# EasyEDA Pro project WearableGasDetect.eprj, board PCB1
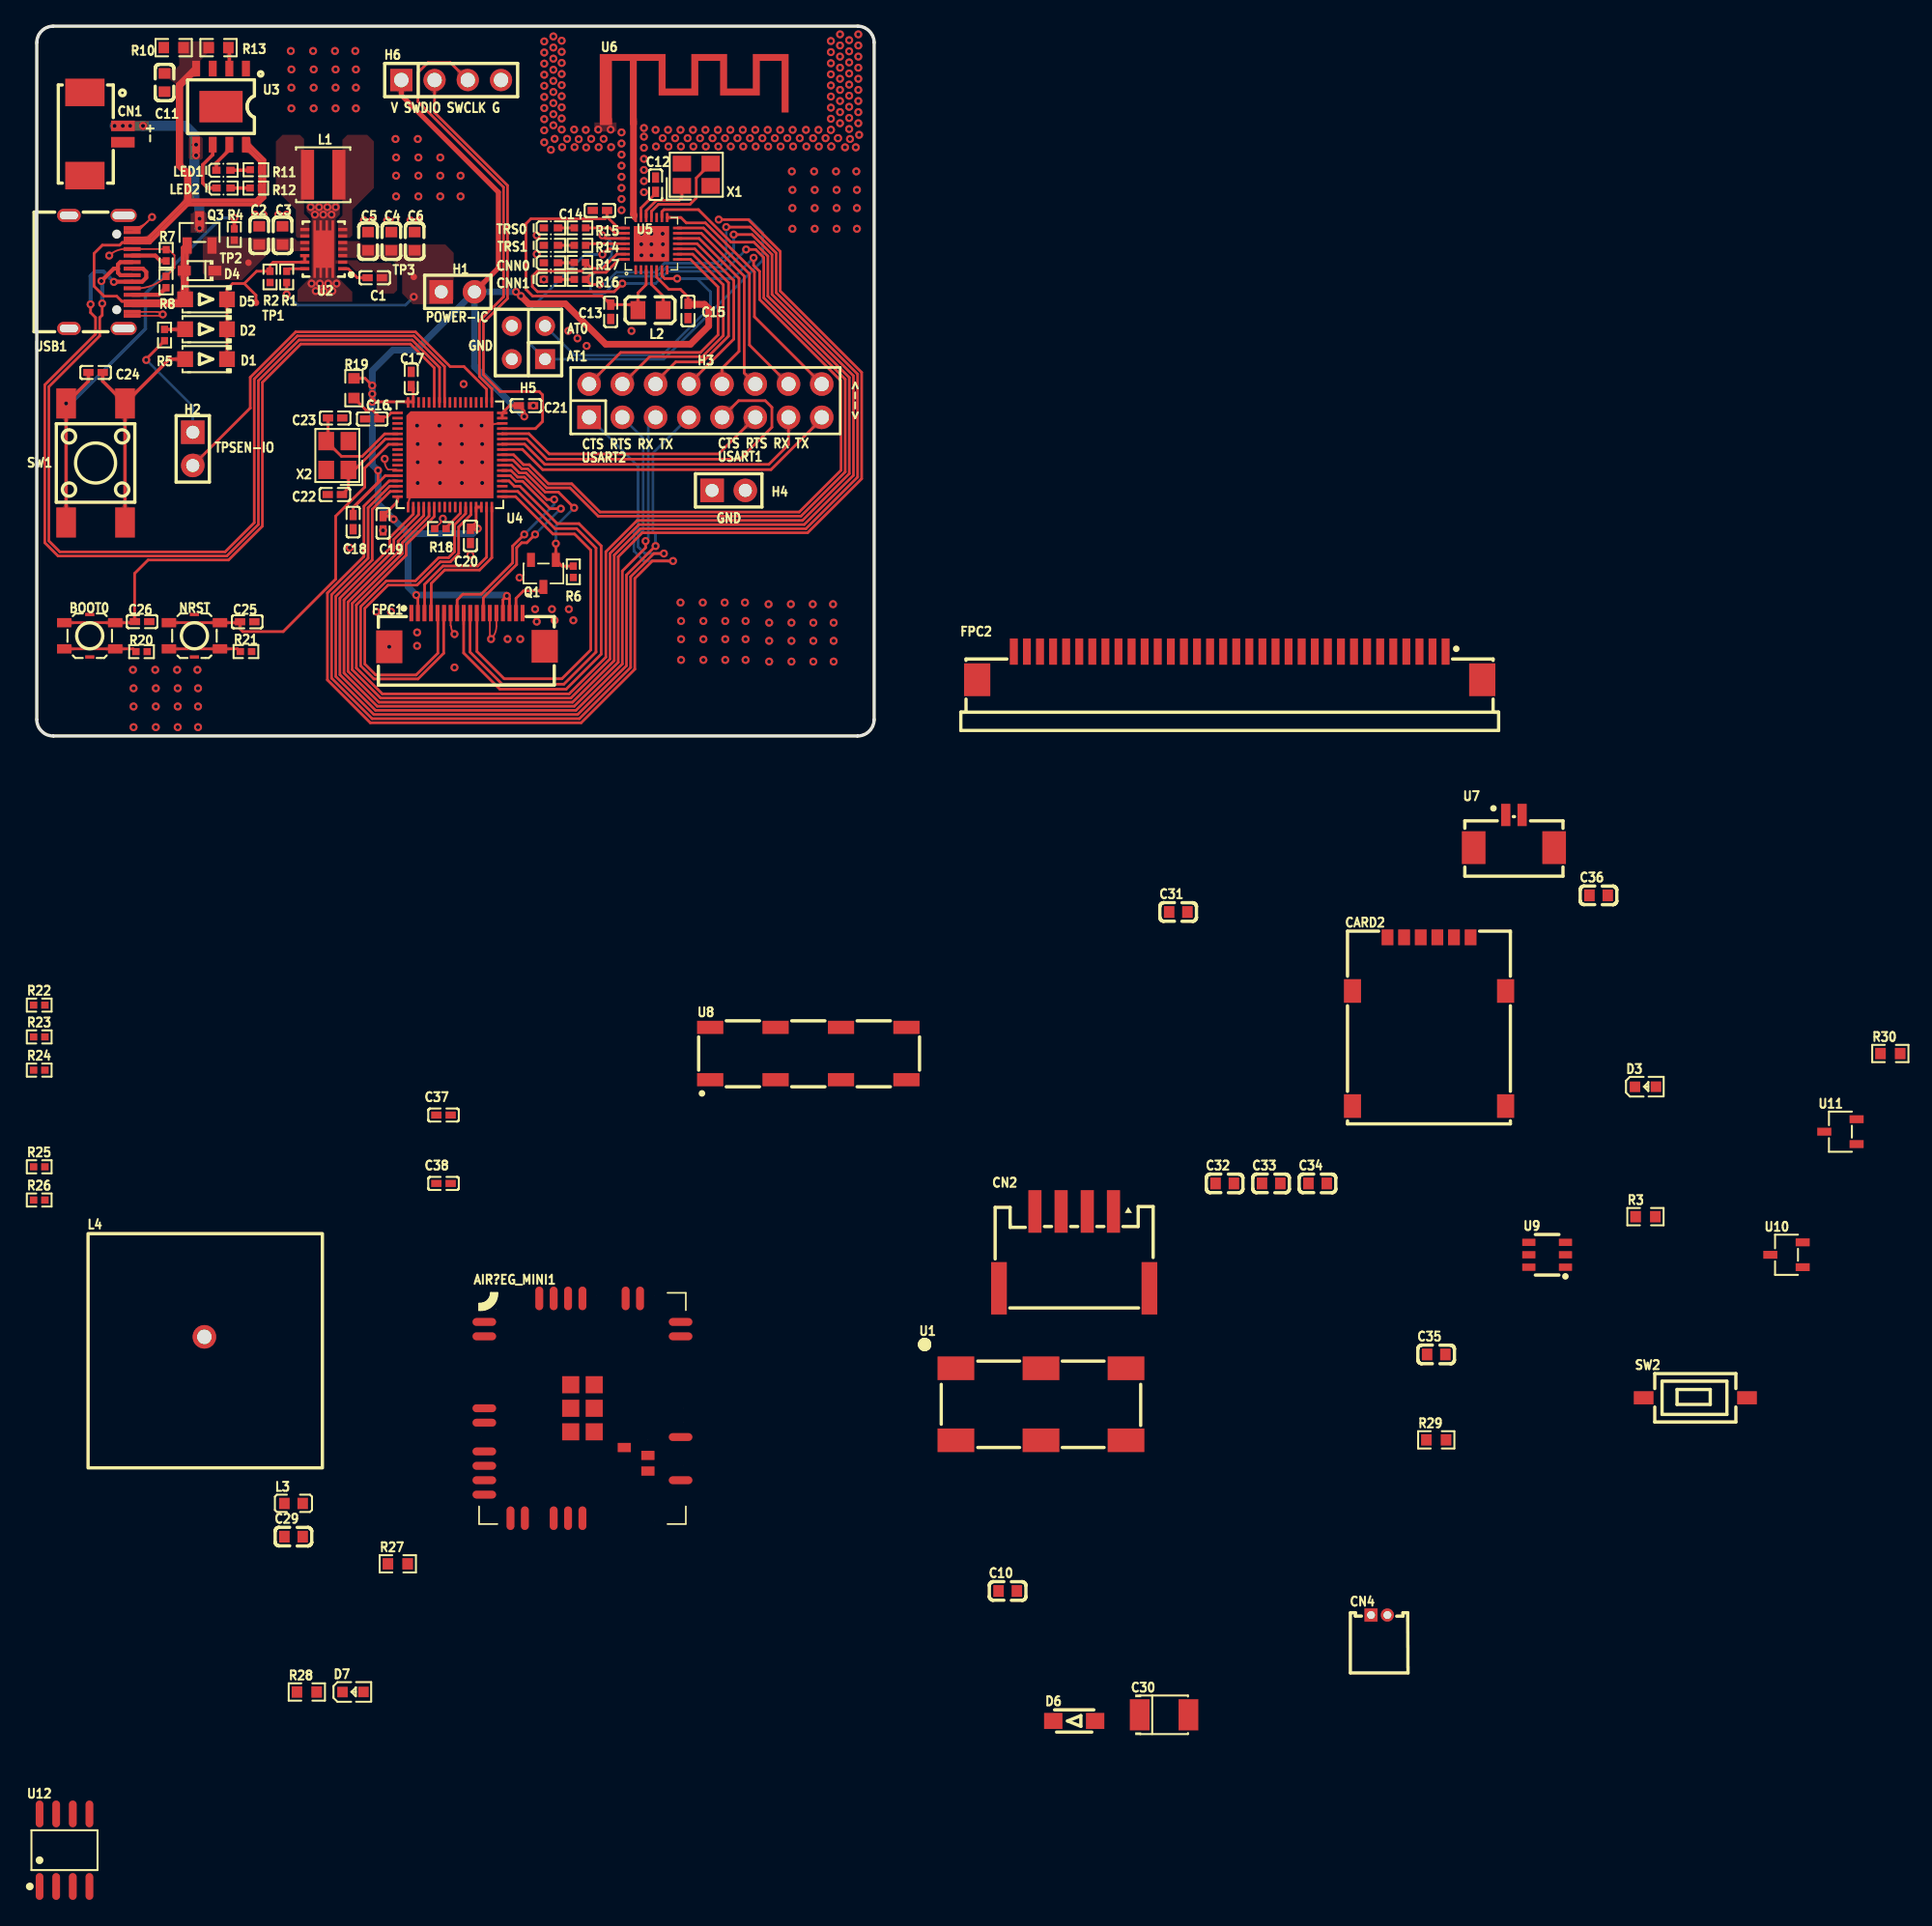
[diagram p6: board, top side]
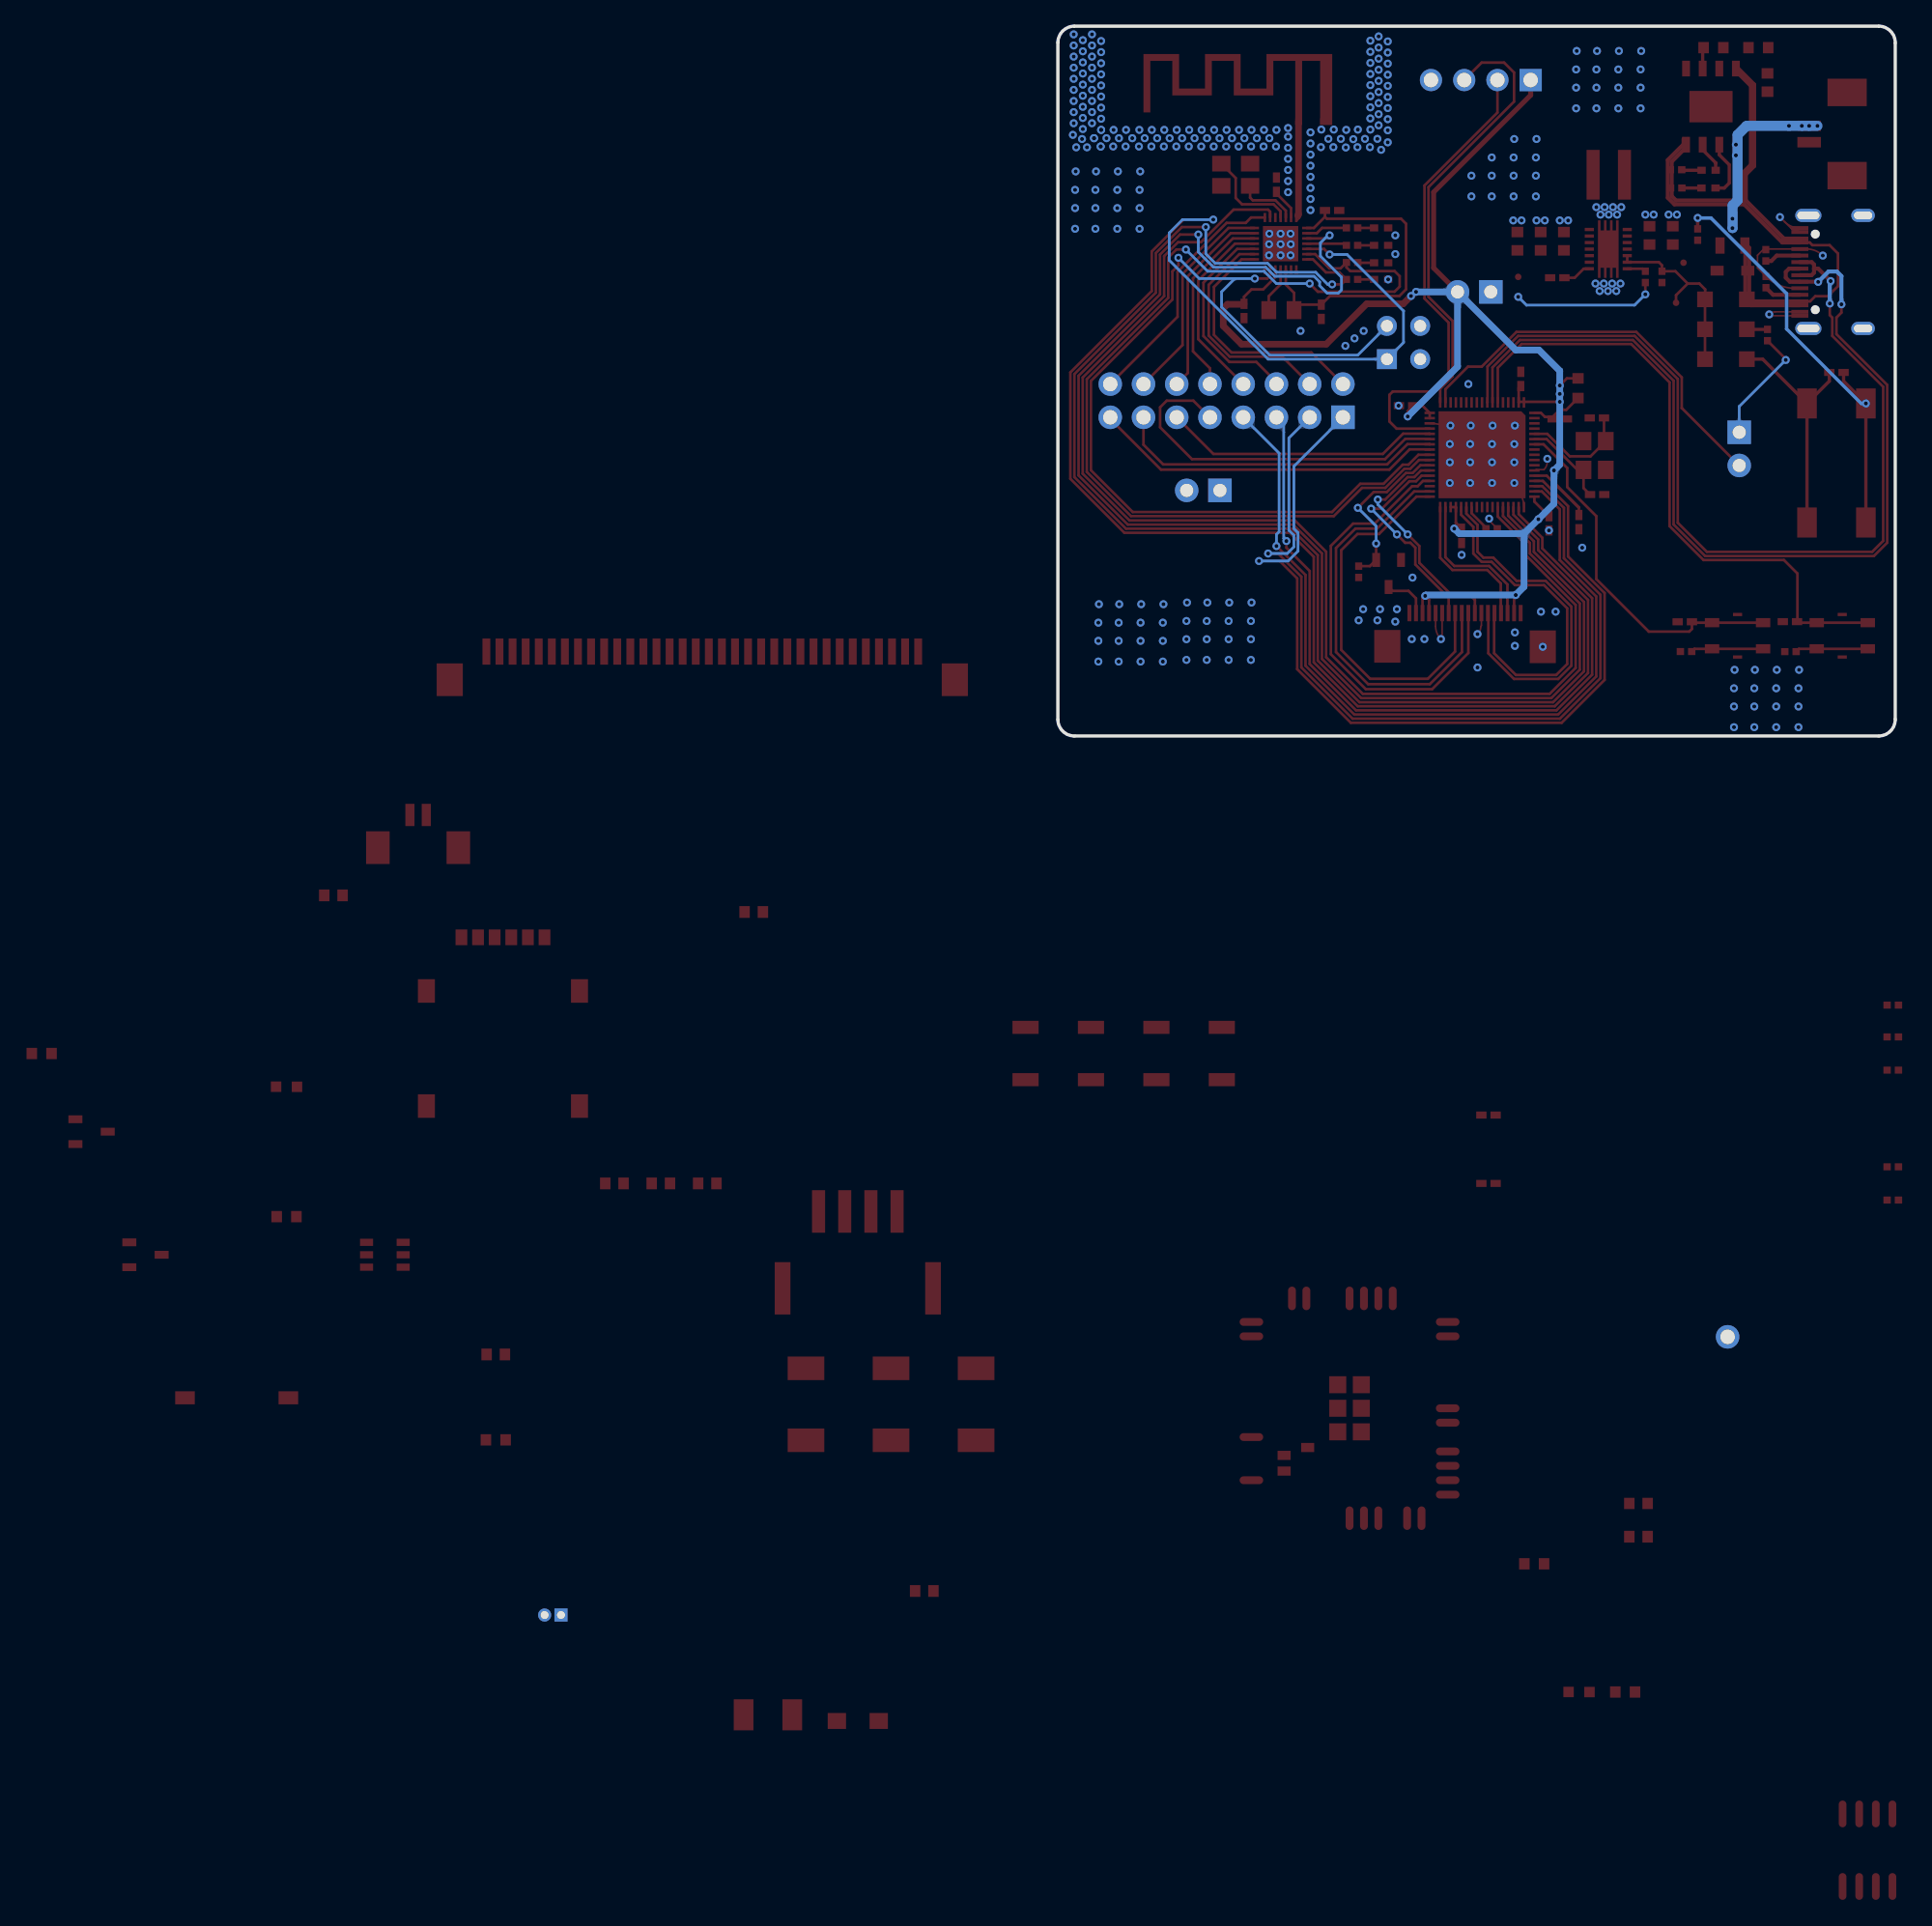
[diagram p7: board, bottom side, seen from below]

Outline 64 x 54.26 mm; copper layers: Top Layer, Bottom Layer. Coordinates in mm from the lower left corner of the outline.
Outline path: 0,52.99 0,1.27 arc(0.37,0.37) 1.27,0 62.73,0 arc(63.62,0.37) 64,1.27 64,52.99 arc(63.62,53.89) 62.73,54.26 1.27,54.26 arc(0.37,53.89) 0,52.99
Stack: Top Layer 0.035mm - / Dielectric1 1.51mm FR4 er 4.5 / Bottom Layer 0.035mm -

## Design rules (mm)
template: JLCPCB Capability(Two Layers Board)
spacing copperThickness1oz (default): track to track 0.102, other pairs 0.152 to 0.3
spacing copperThickness2oz: track to track 0.203, other pairs 0.152 to 0.3
track width copperThickness1oz (default): min 0.127, default 0.254, max 2.54
track width copperThickness2oz: min 0.203, default 0.254, max 2.54
differential pair differentialPair (default): width min 0.127, default 0.254, max 2.54; gap min 0.152, default 0.152
via viaSize (default): diameter min 0.5, default 0.61, max 10; hole min 0.3, default 0.305, max 6.3

## Placement (name value [footprint] x y rotation side)
AIR?EG_MINI1  -  [Air780EG]  41.7 -51.39 0 top
BOOT0  YTS-A007-1C  [SW-SMD_6P-L3.4-W3.4-P2.00-LS4.0]  4.05 7.66 0 top
C1  100nF  [C0402]  25.83 35.03 180 top
C2  10uF  [C0603]  17 38.27 270 top
C3  10uF  [C0603]  18.78 38.27 270 top
C4  22uF  [C0603]  27.1 37.83 270 top
C5  22uF  [C0603]  25.32 37.83 270 top
C6  22uF  [C0603]  28.88 37.83 270 top
C10  4.7UF  [C0603]  74.21 -65.36 0 top
C11  10uF  [C0603]  9.76 49.95 90 top
C12  2.2uF  [C0402]  47.29 42.14 90 top
C13  100nF  [C0402]  43.86 32.43 270 top
C14  2.2uF  [C0402]  43.04 40.17 180 top
C15  2.2uF  [C0402]  49.77 32.49 90 top
C16  100nF  [C0402]  25.64 24.24 180 top
C17  100nF  [C0402]  28.62 27.29 90 top
C18  100nF  [C0402]  24.18 16.35 270 top
C19  100nF  [C0402]  26.47 16.26 270 top
C20  100nF  [C0402]  33.14 15.3 270 top
C21  100nF  [C0402]  37.39 25.25 0 top
C22  12pF  [C0402]  22.78 18.46 0 top
C23  12pF  [C0402]  22.8 24.31 0 top
C24  100nF  [C0402]  4.49 27.79 0 top
C25  100nF  [C0402]  16.08 8.73 180 top
C26  100nF  [C0402]  8.05 8.74 180 top
C29  100nf  [C0603]  19.62 -61.21 0 top
C30  220uF  [CASE-B_3528]  86.16 -74.82 0 top
C31  100nf  [C0603]  87.24 -13.45 0 top
C32  33pf  [C0603]  90.79 -34.2 0 top
C33  33pf  [C0603]  94.34 -34.2 0 top
C34  33pf  [C0603]  97.89 -34.2 0 top
C35  2.2UF  [C0603]  106.95 -47.28 0 top
C36  10UF  [c0603]  119.36 -12.18 0 top
C37  100nF  [C0402]  31.09 -28.98 0 top
C38  100nF  [C0402]  31.09 -34.2 0 top
CARD2  SMN-305-ARP7  [NANO-SIM-SMD_SMN-305-ARP7]  106.41 -21.84 0 top
CN1  HX 1.25-2P WT  [CONN-SMD_2P-P1.25_HX1.25-2PWT]  5.13 46.02 270 top
CN2  HC-PH-4AWT  [CONN-SMD_4P-L2.00_HCTL_HC-PH-4AWT]  79.29 -39.28 0 top
CN4  1.25-2AW  [CONN-TH_2P-P1.25_DEALON_1.25-2AW]  102.6 -67.2 0 top
CNN0  -  [LED_0402]  39.29 36.17 0 top
CNN1  -  [LED_0402]  39.29 34.9 0 top
D1  1N4007 A7  [SOD-123FL_L2.8-W1.8-LS3.7-RD]  12.94 28.81 180 top
D2  1N4007 A7  [SOD-123FL_L2.8-W1.8-LS3.7-RD]  12.94 31.09 180 top
D3  LED  [led0603-rd-yellow]  122.95 -26.81 0 top
D4  1N5819WS  [SOD-323_L1.8-W1.3-LS2.5-RD]  12.44 35.57 180 top
D5  1N4007 A7  [SOD-123FL_L2.8-W1.8-LS3.7-RD]  12.94 33.38 180 top
D6  1N4007W  [SOD-123FL_L3.0-W1.8-LS3.7-RD]  79.29 -75.29 0 top
D7  LED  [led0603-rd-yellow]  24.17 -73.08 0 top
FPC1  FPC-05F-18PH20  [FPC-SMD_18P-P0.50_FPC-05F-18PH20]  32.88 8.11 0 top
FPC2  1.0K-ES-34PWB  [FPC-SMD_34P-P1.00_HDGC_1.0K-ES-34PWB]  91.17 5.38 0 top
H1  -  [HDR-TH_2P-P2.54-V-M-1]  32.18 33.95 0 top
H2  -  [HDR-TH_2P-P2.54-V-M-1]  11.92 21.95 270 top
H3  -  [HDR-TH_16P-P2.54-V-F-R2-C8-S2.54-1]  51.1 25.63 0 top
H4  -  [HDR-TH_2P-P2.54-V-M-1]  52.88 18.78 0 top
H5  -  [HDR-TH_4P-P2.54-V-M-R2-C2-S2.54-1]  37.58 30.08 90 top
H6  -  [HDR-TH_4P-P2.54-V-M]  31.67 50.14 0 top
L1  1.5uH  [IND-SMD_L4.0-W4.0-A]  21.89 42.91 180 top
L2  10uH  [L0805]  46.91 32.55 0 top
L3  2.2nH  [L0603]  19.62 -58.67 0 top
L4  KH-GPS181804-WY  [GPS-ANT-TH_L18.0-W18.0]  12.81 -45.93 0 top
LED1  -  [LED_0402]  14.26 43.25 0 top
LED2  -  [LED_0402]  14.27 41.89 0 top
NRST  YTS-A007-1C  [SW-SMD_6P-L3.4-W3.4-P2.00-LS4.0]  12.05 7.66 0 top
Q1  2N7002Q-7-F-VB  [SOT-23-3_L2.9-W1.4-P1.90-LS2.5-BR]  38.72 12.43 90 top
Q3  SI2301DS  [SOT-23-3_L2.9-W1.3-P1.90-LS2.4-BR]  12.44 38.49 270 top
R1  1M  [R0402]  19.1 35.09 270 top
R2  10K  [R0402]  17.83 35.09 270 top
R3  10k  [r0603]  122.95 -36.74 0 top
R4  4.7K  [R0402]  15.1 38.33 270 top
R5  1K  [R0402]  9.76 30.65 270 top
R6  10K  [R0402]  41.01 12.55 90 top
R7  5.1k  [R0402]  9.89 36.75 90 top
R8  5.1k  [R0402]  9.88 34.7 270 top
R10  100K  [R0603]  10.46 52.62 0 top
R11  4.7K  [R0402]  16.75 43.29 180 top
R12  4.7K  [R0402]  16.74 41.89 180 top
R13  3K  [R0603]  13.89 52.62 180 top
R14  4.7K  [R0402]  41.51 37.51 180 top
R15  4.7K  [R0402]  41.51 38.84 180 top
R16  4.7K  [R0402]  41.51 34.9 180 top
R17  4.7K  [R0402]  41.51 36.2 180 top
R18  10K  [R0402]  30.85 15.85 0 top
R19  0  [R0603]  24.24 26.59 270 top
R20  10K  [R0402]  8.01 6.45 0 top
R21  10K  [R0402]  15.99 6.46 0 top
R22  4.7K  [R0402]  0.19 -20.57 0 top
R23  4.7K  [R0402]  0.19 -23 0 top
R24  4.7K  [R0402]  0.19 -25.54 0 top
R25  4.7K  [R0402]  0.19 -32.93 0 top
R26  4.7K  [R0402]  0.19 -35.47 0 top
R27  1Ω  [R0603]  27.59 -63.28 0 top
R28  10k  [r0603]  20.64 -73.08 0 top
R29  1.5R  [r0603]  106.95 -53.81 0 top
R30  10k  [r0603]  141.66 -24.27 0 top
SW1  -  [SW-SMD_4P-L6.0-W6.0-P4.50-LS9.0-2]  4.49 20.87 90 top
SW2  TS-1092S-B3D2-G  [SW-SMD_L6.1-W3.6-LS7.9]  126.76 -50.59 0 top
TP1  -  [Test-Point-0.5mm]  16.75 33.12 0 top
TP2  -  [Test-Point-0.5mm]  16.18 36.18 0 top
TP3  -  [Test-Point-0.5mm]  28.81 35.09 0 top
TRS0  -  [LED_0402]  39.29 38.84 0 top
TRS1  -  [LED_0402]  39.29 37.51 0 top
U1  MD1506  [ANT-SMD_6P-L15.0-W6.6]  76.75 -51.09 0 top
U2  TPS63021DSJT  [VSON-14_L4.0-W3.0-P0.50-BL-EP_TI_DSJ]  21.93 37.22 90 top
U3  TP4056  [ESOP-8_L4.9-W3.9-P1.27-LS6.0-BL-EP]  14.08 48.11 180 top
U4  CH32V307WCU6  [QFN-68_L8.0-W8.0-P0.40-BL-EP6.7]  31.58 21.5 270 top
U5  CH9142  [QFN-28_L4.0-W4.0-P0.40-BL-EP2.7_CH9142]  46.98 37.63 0 top
U6  -  [通用蓝牙天线]  55.93 46.97 0 top
U7  WAFER-MX1.25-2PWB  [CONN-SMD_2P-P1.25_XUNPU_WAFER-MX1.25-2PWB]  112.89 -7.29 0 top
U8  MD1705  [ANT-SMD_MD1705]  58.97 -24.27 0 top
U9  LY3205  [PG-SOT23-6_L2.9-W1.6-P0.95-LS2.8-BR]  115.43 -39.66 0 top
U10  AO3401  [SOT-23-3_L2.9-W1.6-P1.90-LS2.8-BR]  133.73 -39.66 0 top
U11  AO3401  [SOT-23-3_L2.9-W1.6-P1.90-LS2.8-BR]  137.85 -30.25 0 top
U12  AT24C16C-SSHM-B  [SOIC-8_L4.9-W3.9-P1.27-LS6.0-BL]  2.12 -85.17 0 top
USB1  KH-TYPE-C-16P  [USB-C-SMD_KH-TYPE-C-16P]  4.88 35.48 270 top
X1  32MHz  [CRYSTAL-SMD_4P-L3.2-W2.5-BL]  50.4 42.91 0 top
X2  8MHz  [CRYSTAL-SMD_4P-L3.2-W2.5-BL]  22.97 21.44 90 top

## Footprints (pads in the part's own frame, mm; a bottom-side part is the same pattern mirrored in y, then rotated)
Air780EG
  oval 1.8x0.6 smd: 1(-7.5,6.6) 2(-7.5,5.5) 7(-7.5,0) 8(-7.5,-1.1) 10(-7.5,-3.3) 11(-7.5,-4.4) 12(-7.5,-5.5) 13(-7.5,-6.6) 24(7.5,-5.5) 27(7.5,-2.2) 34(7.5,5.5) 35(7.5,6.6)
  oval 0.6x1.8 smd: 14(-4.4,-8.4) 16(-2.2,-8.402) 17(-1.1,-8.4) 18(0,-8.402) 36(4.4,8.4) 37(3.3,8.4) 40(0,8.4) 41(-1.1,8.4) 42(-2.2,8.4) 43(-3.3,8.4) 95(-5.5,-8.402)
  rect 1x0.7 smd: 59(5,-4.8) 60(5,-3.6) 82(3.2,-3)
  rect 1.3x1.3 smd: 89(-0.9,1.8) 90(-0.9,0) 91(-0.9,-1.8) 92(0.9,-1.8) 93(0.9,0) 94(0.9,1.8)
ANT-SMD_6P-L15.0-W6.6
  rect 2.8x1.8 smd: 1(-6.5,2.75) 2(0,2.75) 3(6.5,2.749) 4(6.5,-2.75) 5(0,-2.75) 6(-6.5,-2.75)
ANT-SMD_MD1705
  rect 2x1 smd: 1(-7.5,-2) 2(-2.5,-2) 3(2.5,-2) 4(7.5,-2) 5(7.5,2) 6(2.5,2) 7(-2.5,2) 8(-7.5,2)
C0402
  rect 0.79x0.54 smd: 1(-0.545,0) 2(0.545,0)
c0603
  rect 0.8x0.9 smd: 1(-0.7,0) 2(0.7,0)
C0603
  rect 0.8x0.9 smd: 1(-0.7,0) 2(0.7,0)
CASE-B_3528
  rect 1.506x2.376 smd: 1(-1.861,0) 2(1.861,0)
CONN-SMD_2P-P1.25_HX1.25-2PWT
  rect 0.8x1.8 smd: 1(-0.625,1.45) 2(0.625,1.45)
  rect 2.1x3 smd: 3(-3.18,-1.45) 4(3.18,-1.45)
CONN-SMD_2P-P1.25_XUNPU_WAFER-MX1.25-2PWB
  rect 0.7x1.7 smd: 1(-0.625,1.25) 2(0.625,1.25)
  rect 1.8x2.5 smd: 3(3.075,-1.25) 4(-3.075,-1.25)
CONN-SMD_4P-L2.00_HCTL_HC-PH-4AWT
  rect 1x3.25 smd: 1(3,2.938) 2(1,2.938) 3(-1,2.938) 4(-3,2.938)
  rect 1.2x4 smd: 5(5.75,-2.938) 6(-5.75,-2.938)
CONN-TH_2P-P1.25_DEALON_1.25-2AW
  rect 1x1 hole 0.6: 1(-0.625,0)
  round 1 hole 0.6: 2(0.625,0)
CRYSTAL-SMD_4P-L3.2-W2.5-BL
  rect 1.4x1.2 smd: 1(-1.1,-0.85) 2(1.1,-0.85) 3(1.1,0.85) 4(-1.1,0.85)
ESOP-8_L4.9-W3.9-P1.27-LS6.0-BL-EP
  rect 0.6x1.2 smd: 1(-1.905,-2.909) 2(-0.635,-2.909) 3(0.635,-2.909) 4(1.905,-2.909) 5(1.905,2.909) 6(0.635,2.909) 7(-0.635,2.909) 8(-1.905,2.909)
  rect 3.3x2.4 smd: 9(0,0)
FPC-SMD_18P-P0.50_FPC-05F-18PH20
  rect 0.3x1.25 smd: 1(-4.25,1.288) 2(-3.75,1.288) 3(-3.25,1.288) 4(-2.75,1.288) 5(-2.25,1.288) 6(-1.75,1.288) 7(-1.25,1.288) 8(-0.75,1.288) 9(-0.25,1.288) 10(0.25,1.288) 11(0.75,1.288) 12(1.25,1.288) 13(1.75,1.288) 14(2.25,1.288) 15(2.75,1.288) 16(3.25,1.288) 17(3.75,1.288) 18(4.25,1.288)
  rect 2x2.5 smd: 19(-5.94,-1.288) 20(5.94,-1.252)
FPC-SMD_34P-P1.00_HDGC_1.0K-ES-34PWB
  rect 0.6x2 smd: 1(16.5,1.075) 2(15.5,1.075) 3(14.5,1.075) 4(13.5,1.075) 5(12.5,1.075) 6(11.5,1.075) 7(10.5,1.075) 8(9.5,1.075) 9(8.5,1.075) 10(7.5,1.075) 11(6.5,1.075) 12(5.5,1.075) 13(4.5,1.075) 14(3.5,1.075) 15(2.5,1.075) 16(1.5,1.075) 17(0.5,1.075) 18(-0.5,1.075) 19(-1.5,1.075) 20(-2.5,1.075) 21(-3.5,1.075) 22(-4.5,1.075) 23(-5.5,1.075) 24(-6.5,1.075) 25(-7.5,1.075) 26(-8.5,1.075) 27(-9.5,1.075) 28(-10.5,1.075) 29(-11.5,1.075) 30(-12.5,1.075) 31(-13.5,1.075) 32(-14.5,1.075) 33(-15.5,1.075) 34(-16.5,1.075)
  rect 2x2.5 smd: 35(-19.3,-1.075) 36(19.3,-1.075)
GPS-ANT-TH_L18.0-W18.0
  round 1.8 hole 1.1: 1(0,0)
HDR-TH_2P-P2.54-V-M-1
  rect 1.8x1.8 hole 1: 1(-1.27,0)
  round 1.8 hole 1: 2(1.27,0)
HDR-TH_4P-P2.54-V-M
  rect 1.7x1.7 hole 1.1: 1(-3.81,0)
  round 1.7 hole 1.1: 2(-1.27,0) 3(1.27,0) 4(3.81,0)
HDR-TH_4P-P2.54-V-M-R2-C2-S2.54-1
  rect 1.524x1.524 hole 0.914: 1(-1.27,-1.27)
  round 1.524 hole 0.914: 2(-1.27,1.27) 3(1.27,-1.27) 4(1.27,1.27)
HDR-TH_16P-P2.54-V-F-R2-C8-S2.54-1
  rect 1.8x1.8 hole 1.1: 1(-8.89,-1.27)
  round 1.8 hole 1.1: 2(-8.89,1.27) 3(-6.35,-1.27) 4(-6.35,1.27) 5(-3.81,-1.27) 6(-3.81,1.27) 7(-1.27,-1.27) 8(-1.27,1.27) 9(1.27,-1.27) 10(1.27,1.27) 11(3.81,-1.27) 12(3.81,1.27) 13(6.35,-1.27) 14(6.35,1.27) 15(8.89,-1.27) 16(8.89,1.27)
IND-SMD_L4.0-W4.0-A
  rect 1x3.8 smd: 1(-1.2,0) 2(1.2,0)
L0603
  rect 0.8x0.864 smd: 1(-0.7,0) 2(0.7,0)
L0805
  rect 1.133x1.377 smd: 1(-0.966,0) 2(0.966,0)
led0603-rd-yellow
  rect 0.8x0.8 smd: 1(-0.799,-0.004) 2(0.799,0.004)
LED_0402
  rect 0.637x0.541 smd: 1(-0.538,0) 2(0.538,0)
NANO-SIM-SMD_SMN-305-ARP7
  rect 0.9x1.2 smd: 1(-3.175,6.45) 2(-0.635,6.45) 3(1.905,6.45) 5(-1.905,6.45) 6(0.635,6.45) 7(3.175,6.45)
  rect 1.3x1.8 smd: 8(-5.85,-6.45) 9(-5.85,2.35) 10(5.85,2.35) 11(5.85,-6.45)
PG-SOT23-6_L2.9-W1.6-P0.95-LS2.8-BR
  rect 1x0.55 smd: 1(1.4,-0.95) 2(1.4,0) 3(1.4,0.95) 4(-1.4,0.95) 5(-1.4,0) 6(-1.4,-0.95)
QFN-28_L4.0-W4.0-P0.40-BL-EP2.7_CH9142
  rect 2.7x2.7 smd: 0(0.001,0)
  rect 0.2x0.7 smd: 1(-1.2,-2) 2(-0.8,-2) 3(-0.4,-2) 4(-0.001,-2) 5(0.4,-2) 6(0.8,-2) 7(1.2,-2) 15(1.2,2) 16(0.8,2) 17(0.4,2) 18(0,2) 19(-0.4,2) 20(-0.8,2) 21(-1.2,2)